# EasyEDA Pro project Arduino UNO DIY.eprj, schematic Schematic3B
Board Name: ATtiny Tiny Shield; Create Date: 2025-09-24; Page Name: P1; Project Name: Arduino UNO DIY; Schematic Name: Schematic3B; Update Date: 2025-09-24; Company: m039; Drawn: Dmitry Mozgin; Page Size: A4; Version: V1.0
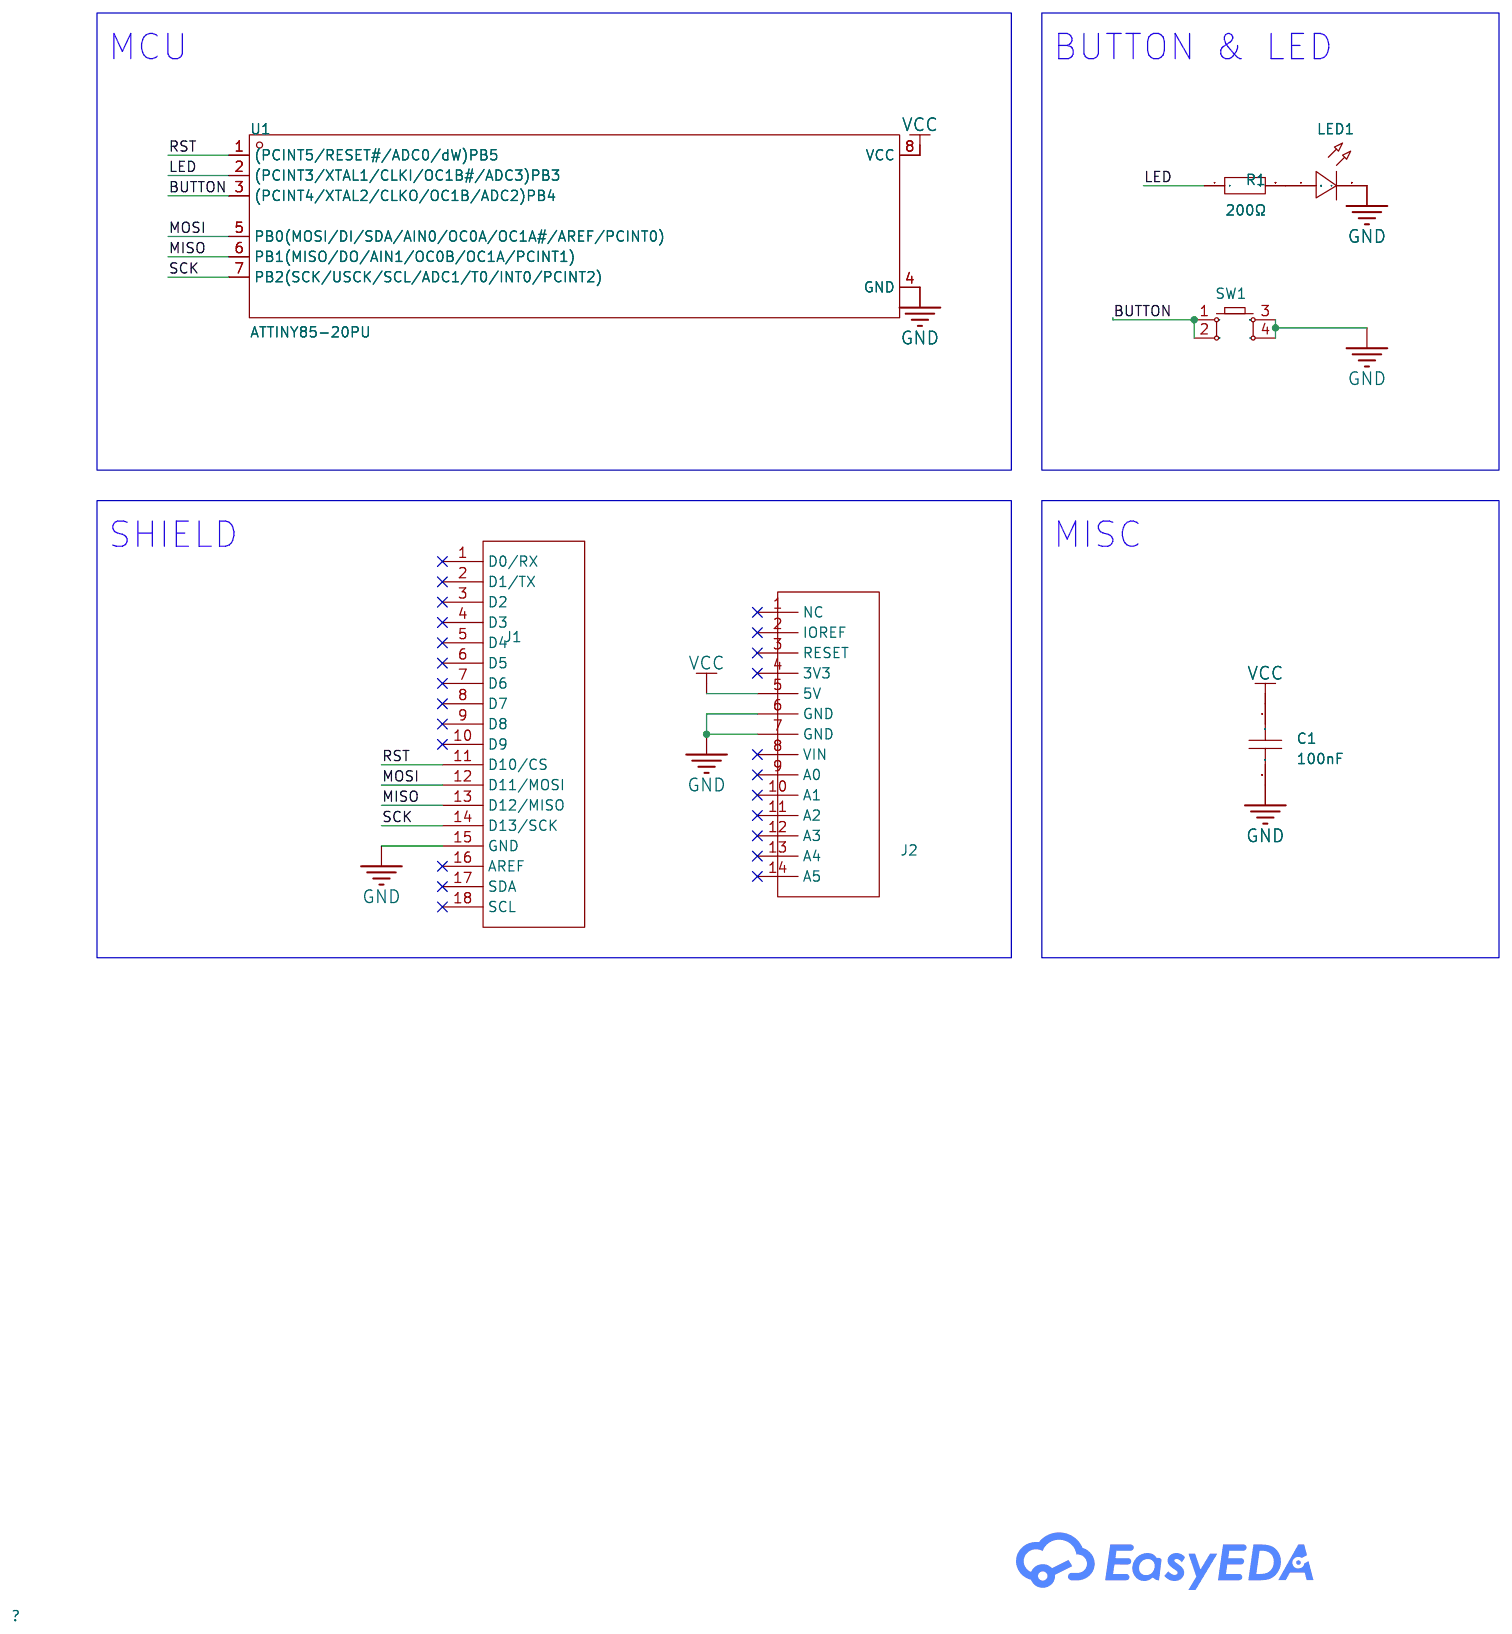
[diagram p3: schematic sheet]

## Parts
C1  100nF  [CAP-TH_L4.8-W2.4-P5.08-D0.6]
J1  -  [Arduino Uno Top Header]
J2  -  [Arduino Uno Bottom Header]
LED1  -  [LED-TH_BD3.0-P2.54-FD]
R1  200Ω  [RES-TH_BD1.8-L3.2-P7.20-D0.4]
SW1  -  [KEY-TH_4P-L6.0-W6.0-P3.90-LS6.5]
U1  ATTINY85-20PU  [PDIP-8_L9.3-W6.4-P2.54-LS7.9-BL-1]

## Library data of the parts
C1 = CC1H221KC1EDB44B1100: LCSC Part Name: 220pF ±10% 50V; Supplier Part: C2832511; Manufacturer: Dersonic(德尔创); Supplier Footprint: 插件,P=5.08mm; JLCPCB Part Class: Extended Part; Datasheet: https://atta.szlcsc.com/upload/public/pdf/source/20211103/ADF2DBCED823A6AEFAA1F6C91B9CD8F4.pdf; Supplier: LCSC; Tolerance: ±10%; Voltage Rating: 50V; Pin Spacing: 5.08mm; Temperature Coefficient: Y5P; Diameter: 4.8mm; Body Thickness: 2.4mm
J1 = Arduino Uno Top Header
J2 = Arduino Uno Header Bottom
LED1 = LED_TH-R_3mm: Supplier Footprint: Through
R1 = Res_AXIAL-1/8W: Supplier Footprint: Through
SW1 = Key_TH_6x6x4.5: Supplier Footprint: Through
U1 = ATTINY85-20PU: Supplier Part: C965497; Manufacturer: MICROCHIP(美国微芯); Supplier Footprint: PDIP-8; JLCPCB Part Class: Extended Part; Datasheet: https://atta.szlcsc.com/upload/public/pdf/source/20230316/52E8372B25B5C60283349350D649F2D1.pdf; Supplier: LCSC; CPU Core: AVR; CPU Maximum Speed: 20MHz; Program Storage Size: 8KB; Program Memory Type: FLASH; EEPROM: 512Byte; Number of I/O: 6; ADC (Bit): 10bit; Voltage - Supply: 2.7V~5.5V

## Nets
GND: C1.2 J1.15(GND) J2.6(GND) J2.7(GND) LED1.2(A) SW1.3 SW1.4 U1.4(GND)
VCC: C1.1 J2.5(5V) U1.8(VCC)
BUTTON: SW1.1 SW1.2 U1.3((PCINT4/XTAL2/CLKO/OC1B/ADC2)PB4)
LED: R1.1 U1.2((PCINT3/XTAL1/CLKI/OC1B#/ADC3)PB3)
MISO: J1.13(D12/MISO) U1.6(PB1(MISO/DO/AIN1/OC0B/OC1A/PCINT1))
MOSI: J1.12(D11/MOSI) U1.5(PB0(MOSI/DI/SDA/AIN0/OC0A/OC1A#/AREF/PCINT0))
RST: J1.11(D10/CS) U1.1((PCINT5/RESET#/ADC0/dW)PB5)
SCK: J1.14(D13/SCK) U1.7(PB2(SCK/USCK/SCL/ADC1/T0/INT0/PCINT2))
$1N517: LED1.1(C) R1.2

Not connected (* = marked no-connect by the designer): J1 1(D0/RX)* 2(D1/TX)* 3(D2)* 4(D3)* 5(D4)* 6(D5)* 7(D6)* 8(D7)* 9(D8)* 10(D9)* 16(AREF)* 17(SDA)* 18(SCL)*; J2 1(NC)* 2(IOREF)* 3(RESET)* 4(3V3)* 8(VIN)* 9(A0)* 10(A1)* 11(A2)* 12(A3)* 13(A4)* 14(A5)*

## Notes on the sheet
- MCU
- BUTTON & LED
- SHIELD
- MISC
